# EasyEDA Pro project cubicat_pcb.eprj, board PCB_audio
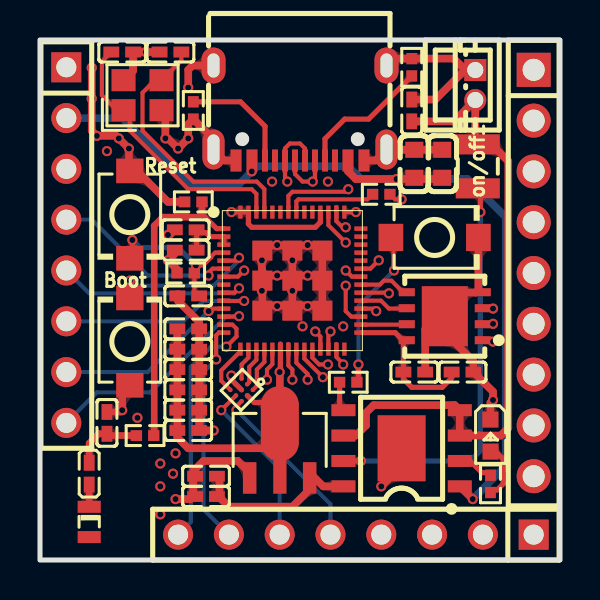
[diagram p11: board, top side]
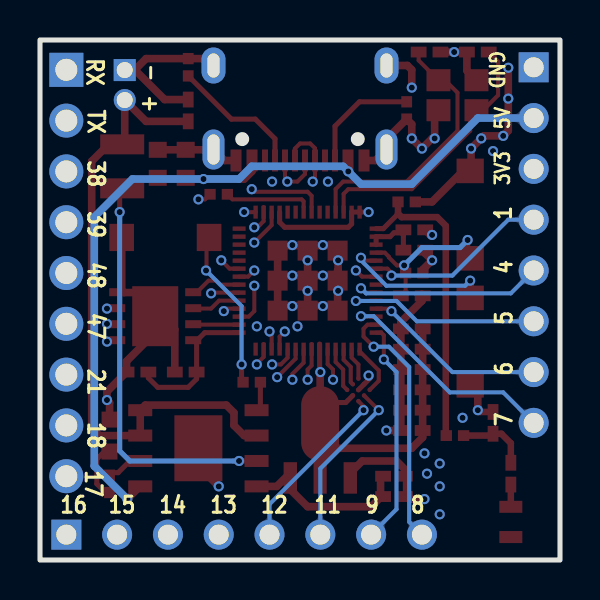
[diagram p12: board, bottom side, seen from below]

Outline 26 x 26 mm; copper layers: Top Layer, GND, PWR, Bottom Layer. Coordinates in mm from the lower left corner of the outline.
Outline path: rectangle 0,26 26,0
Stack: Top Layer 0.035mm 外层铜厚1oz / Dielectric1 0.2104mm 7628 RC49% 8.6mil / GND 0.0152mm 内层铜厚 / Dielectric2 1.065mm 1.1mm H/HOZ 含铜 / PWR 0.0152mm 内层铜厚 / Dielectric3 0.2104mm 7628 RC49% 8.6mil / Bottom Layer 0.035mm 外层铜厚1oz

## Design rules (mm)
net D-: USB-OTG
net D+: USB-OTG
template: 自定义配置
spacing copperThickness1oz (default): track to track 0.102, other pairs 0.152 to 0.3
spacing copperThickness2oz: track to track 0.203, other pairs 0.152 to 0.3
track width copperThickness1oz (default): min 0.127, default 0.254, max 2.54
track width copperThickness2oz: min 0.203, default 0.254, max 2.54
differential pair 90ohm (default): width min 0.203, default 0.203, max 0.229; gap min 0.152, default 0.203
via viaSize (default): diameter min 0.5, default 0.508, max 10; hole min 0.3, default 0.305, max 6.299

## Placement (name value [footprint] x y rotation side)
ANT1  KH-1608-H08  [ANT-SMD_L1.7-W0.9]  2.46 1.9 90 top
BAT1  A1501WV-2P  [CONN-TH_A1501WV-2P]  21.76 23.75 270 top
Boot  TS-1088-AR02016  [SW-SMD_L3.9-W3.0-P4.45]  4.49 10.92 90 top
C4  10uF  [C0402]  18.59 22.48 90 top
C6  10uF  [C0402]  8.3 3.17 180 top
C7  10uF  [C0603]  20.11 19.81 270 top
C8  10uF  [C0603]  18.72 19.81 270 top
C9  10uF  [C0402]  8.3 4.19 180 top
C13  10uF  [C0402]  7.41 7.49 180 top
C14  100nF  [C0402]  7.41 6.47 180 top
C15  1uF  [C0402]  7.41 13.21 0 top
C16  10uF  [C0402]  7.41 9.52 180 top
C17  1uF  [C0402]  7.41 11.56 180 top
C18  100nF  [C0402]  7.28 16.51 0 top
C20  15pF  [C0402]  4.11 25.4 0 top
C21  15pF  [C0402]  6.52 25.4 0 top
C22  1uF  [C0402]  7.41 8.51 180 top
C23  100nF  [C0402]  18.72 9.4 180 top
C24  1uF  [C0402]  21.13 9.4 180 top
C25  1.5pF  [C0402]  3.35 6.86 270 top
C30  10uF  [C0402]  7.41 10.54 180 top
ESP32S3R8  -  [esp32s3R8]  12.62 13.97 0 top
H1  PZ254V-11-09P  [HDR-TH_9P-P2.54-V-M]  24.68 14.35 270 top
L1  2.2uH  [IND-SMD_L2.5-W2.0_MHCHL2520]  21.89 19.68 90 top
L2  2nH  [L0402]  7.28 15.49 0 top
L3  5.6nH  [L0402]  2.46 4.32 90 top
LED1  19-213/Y2C-CQ2R2L/3T(CY)  [LED0603-RD-YELLOW]  22.53 6.22 270 top
on/off1  TS-1088-AR02016  [SW-SMD_L3.9-W3.0-P4.45]  19.73 16.13 0 top
Q1  AMS1117-3.3  [SOT-89_L4.5-W2.5-P1.50-LS4.2-BR]  11.98 5.46 270 top
R5  200Ω  [R0402]  22.53 3.81 90 top
R7  10kΩ  [R0402]  7.28 14.35 180 top
R9  5.1kΩ  [R0402]  7.67 22.48 90 top
R10  5.1kΩ  [R0402]  18.59 24.64 90 top
R11  10kΩ  [R0402]  15.41 8.89 0 top
R14  0Ω  [R0402]  5.25 6.22 0 top
R15  0Ω  [R0402]  7.67 17.91 0 top
R22  470Ω  [R0402]  17.06 18.29 0 top
Reset  TS-1088-AR02016  [SW-SMD_L3.9-W3.0-P4.45]  4.49 17.27 270 top
U6  IP5305T  [ESOP-8_L4.9-W3.9-P1.27-LS6.0-BL-EP]  18.08 5.59 90 top
U22  HB-PH3-25418PB2GOP  [HDR-TH_8P-P2.54-V-M]  15.79 1.27 180 top
U24  HB-PH3-25418PB2GOP  [HDR-TH_8P-P2.54-V-M]  1.32 15.75 270 top
U25  MAX98357AEWL+T  [WLP-9_L1.4-W1.3-P0.40-R3-C3-BR]  10.08 8.51 45 top
U26  W25Q64JVXGIQ  [XSON-8_L4.0-W4.0-P0.80-TL-EP]  20.24 12.19 180 top
USB1  TYPE-C 16PIN 2MD(073)  [USB-C-SMD_TYPE-C-6PIN-2MD-073]  13 22.35 180 top
X1  40MHz  [CRYSTAL-SMD_4P-L2.5-W2.0-BL]  5.13 23.24 0 top

## Footprints (pads in the part's own frame, mm; a bottom-side part is the same pattern mirrored in y, then rotated)
ANT-SMD_L1.7-W0.9
  rect 0.6x1.15 smd: 1(-0.756,0) 2(0.756,0)
C0402
  rect 0.79x0.54 smd: 1(-0.545,0) 2(0.545,0)
C0603
  rect 0.8x0.9 smd: 1(-0.7,0) 2(0.7,0)
CONN-TH_A1501WV-2P
  rect 1.1x1.1 hole 0.8: 1(-0.75,0)
  round 1.1 hole 0.8: 2(0.75,0)
CRYSTAL-SMD_4P-L2.5-W2.0-BL
  rect 1.2x1.1 smd: 1(-0.95,-0.75) 2(0.95,-0.75) 3(0.95,0.75) 4(-0.95,0.75)
ESOP-8_L4.9-W3.9-P1.27-LS6.0-BL-EP
  rect 0.6x1.2 smd: 1(-1.905,-2.909) 2(-0.635,-2.909) 3(0.635,-2.909) 4(1.905,-2.909) 5(1.905,2.909) 6(0.635,2.909) 7(-0.635,2.909) 8(-1.905,2.909)
  rect 3.3x2.4 smd: 9(0,0)
esp32s3R8
  rect 0.65x0.22 smd: 1(-3.425,2.6) 2(-3.425,2.2) 3(-3.425,1.8) 4(-3.425,1.4) 5(-3.425,1) 6(-3.425,0.6) 7(-3.425,0.2) 8(-3.425,-0.2) 9(-3.425,-0.6) 10(-3.425,-1) 11(-3.425,-1.4) 12(-3.425,-1.8) 13(-3.425,-2.2) 14(-3.425,-2.6) 29(3.425,-2.6) 30(3.425,-2.2) 31(3.425,-1.8) 32(3.425,-1.4) 33(3.425,-1) 34(3.425,-0.6) 35(3.425,-0.2) 36(3.425,0.2) 37(3.425,0.6) 38(3.425,1) 39(3.425,1.4) 40(3.425,1.8) 41(3.425,2.2) 42(3.425,2.6)
  rect 0.22x0.65 smd: 15(-2.6,-3.425) 16(-2.2,-3.425) 17(-1.8,-3.425) 18(-1.4,-3.425) 19(-1,-3.425) 20(-0.6,-3.425) 21(-0.2,-3.425) 22(0.2,-3.425) 23(0.6,-3.425) 24(1,-3.425) 25(1.4,-3.425) 26(1.8,-3.425) 27(2.2,-3.425) 28(2.6,-3.425) 43(2.6,3.425) 44(2.2,3.425) 45(1.8,3.425) 46(1.4,3.425) 47(1,3.425) 48(0.6,3.425) 49(0.2,3.425) 50(-0.2,3.425) 51(-0.6,3.425) 52(-1,3.425) 53(-1.4,3.425) 54(-1.8,3.425) 55(-2.2,3.425) 56(-2.6,3.425)
  rect 1x1 smd: 57(-1.5,1.5) 57(-1.5,0) 57(-1.5,-1.5) 57(0,1.5) 57(0,0) 57(0,-1.5) 57(1.5,1.5) 57(1.5,0) 57(1.5,-1.5)
HDR-TH_8P-P2.54-V-M
  rect 1.5x1.5 hole 1: 1(-8.89,0)
  round 1.5 hole 1: 2(-6.35,0) 3(-3.81,0) 4(-1.27,0) 5(1.27,0) 6(3.81,0) 7(6.35,0) 8(8.89,0)
HDR-TH_9P-P2.54-V-M
  rect 1.7x1.7 hole 1.1: 1(-10.16,0)
  round 1.7 hole 1.1: 2(-7.62,0) 3(-5.08,0) 4(-2.54,0) 5(0,0) 6(2.54,0) 7(5.08,0) 8(7.62,0) 9(10.16,0)
IND-SMD_L2.5-W2.0_MHCHL2520
  rect 1x2.2 smd: 1(-1.1,0) 2(1.1,0)
L0402
  rect 0.79x0.54 smd: 1(-0.545,0) 2(0.545,0)
LED0603-RD-YELLOW
  rect 0.8x0.8 smd: 1(-0.799,-0.004) 2(0.799,0.004)
R0402
  rect 0.566x0.54 smd: 1(-0.433,0) 2(0.433,0)
SOT-89_L4.5-W2.5-P1.50-LS4.2-BR
  rect 1.575x0.672 smd: 1(1.356,-1.5) 3(1.356,1.5)
  custom 5.377x1.9 smd: 2(-1.356,0.009)
SW-SMD_L3.9-W3.0-P4.45
  rect 1.23x1.36 smd: 1(-2.185,0) 2(2.185,0)
USB-C-SMD_TYPE-C-6PIN-2MD-073
  rect 0.55x1.1 smd: 1(-3.2,2.375) 2(-2.4,2.375) 11(2.4,2.375) 12(3.2,2.375)
  rect 0.3x1.1 smd: 3(-1.75,2.375) 4(-1.25,2.375) 5(-0.75,2.375) 6(-0.25,2.375) 7(0.25,2.375) 8(0.75,2.375) 9(1.25,2.375) 10(1.75,2.375)
  oval 1.1x2 hole 0.6x1.5: 13(-4.325,1.825) 14(4.325,1.825)
  oval 1.2x1.8 hole 0.6x1.2: 13(-4.325,-2.375) 14(4.325,-2.375)
WLP-9_L1.4-W1.3-P0.40-R3-C3-BR
  round 0.23 smd: A1(0.4,-0.4) A2(0,-0.4) A3(-0.4,-0.4) B1(0.4,0) B2(0,0) B3(-0.4,0) C1(0.4,0.4) C2(0,0.4) C3(-0.4,0.4)
XSON-8_L4.0-W4.0-P0.80-TL-EP
  rect 0.8x0.4 smd: 1(-1.9,1.2) 2(-1.9,0.4) 3(-1.9,-0.4) 4(-1.9,-1.2) 5(1.9,-1.2) 6(1.9,-0.4) 7(1.9,0.4) 8(1.9,1.2)
  rect 2.3x3 smd: 9(0,0)

## Nets
As in the schematic.

Pads without a net: ANT1 1; ESP32S3R8 8 28 38 39 40 41 42 51 52; USB1 3 9

## Via types
v1: diameter 0.508, hole 0.305, Top Layer to Bottom Layer, 85 vias

## Routing (per net, layer and track width the routed paths; a pad name or vN(x,y) marks a point on that pad's centre or on a via; arc(x,y) is an arc through that point)
GND: length 86.4
  Top Layer w0.254: v1(9.57,9.22) 9.5,9.15 9.5,9.09 U25.C2 U25.B2
  Top Layer w0.33: v1(4.11,7.49) 4.02,7.4 C25.1
  Top Layer w0.381: C23.1 19.26,11.53 19.9,12.17 ; USB1.1 16.78,19.97 USB1.13 17.34,20.51 C8.1 C7.1 ; 6.9,13.3 6.9,12.95 7.96,11.9 C17.1 C30.1 C16.1 C22.1 C13.1 C14.1 v1(8.68,6.47) ; v1(17.06,3.68) 18.08,4.7 U6.9 ; 11.09,14.22 v1(11.86,14.22) 12.62,14.22 ; 11.09,14.22 11.09,14.45 11.12,14.48 11.09,14.5 v1(11.09,14.98) 11.12,15.01 11.12,15.72 12.62,15.72 ; 11.09,14.22 v1(11.09,13.46) 11.12,13.44 11.12,12.72 12.62,12.72 ; 12.62,12.72 v1(12.62,13.46) 12.62,14.22 ; 12.62,12.72 14.12,12.72 14.12,14.22 ; 21.27,24.5 21.24,24.5 19.77,23.02 C4.2 ; 21.27,24.5 20.69,25.07 R10.2 17.62,25.07 17.32,24.77 USB1.13 ; 21.27,24.5 BAT1.1 ; 14.12,14.22 14.12,15.72 12.62,15.72 ; 14.12,14.22 v1(13.38,14.22) 12.62,14.22 ; R15.1 6.4,17.91 4.45,19.85 v1(4.45,20.57) v1(3.94,21.08) 3.81,21.21 v1(2.84,21.21) 2.59,21.46 v1(2.59,23.07) v1(2.59,24.61) ; X1.2 6.27,22.3 v1(6.27,21.08) 6.4,21.08 v1(6.9,20.57) v1(7.41,21.08) 7.41,21.79 R9.1 8.68,21.03 USB1.14 9.22,19.97 USB1.12 ; 12.62,15.72 v1(12.62,14.98) 12.62,14.22 ; C21.1 v1(5.29,25.4) C20.2 4.66,24.47 X1.4 ; v1(4.11,7.49) 4.11,8.35 Boot.1 ; 19.9,12.17 19.9,11.7 21.67,9.94 C24.1 22.65,8.42 v1(22.65,8) 22.52,7.87 22.52,7.27 ; 19.9,12.17 21.1,13.37 21.8,13.37 21.92,13.48 on/off1.2 ; USB1.14 7.63,24.72 7.41,24.51 v1(7.41,23.62) ; v1(6.4,16.25) 6.49,16.25 C18.1 ; v1(6.78,3.05) 7.54,3.05 7.67,3.17 7.67,4.44 8.17,4.95 9.89,4.95 10.48,4.36
  vias: v1(3.35,20.44) v1(4.87,7.11) v1(6.01,4.82) v1(6.01,3.68) v1(6.01,2.28) v1(6.65,4.32) v1(6.78,5.33) v1(11.6,18.92) v1(11.86,15.75) v1(11.86,12.7) v1(13.13,11.68) v1(13.38,15.75) v1(13.38,12.7) v1(14.4,18.92) v1(15.16,11.68)
VBUS_5V: length 46.4
  Top Layer w0.381: USB1.11 10.6,19.44 v1(10.59,19.43) ; C7.2 20.05,19.05 v1(17.83,19.05) 15.79,19.05 15.4,19.44 USB1.2 ; v1(21.64,3.05) 21,3.68 U6.1
  Bottom Layer w0.381: U24.2 4.11,22.1 7.41,18.79 9.95,18.79 v1(10.59,19.43) 10.84,19.68 15.41,19.68 16.05,19.05 v1(17.83,19.05) 21.38,19.05 23.29,17.14 23.29,4.7 v1(21.64,3.05)
VCC_3V3: length 35.3
  Top Layer w0.254: v1(9.57,17.4) 10.41,17.4 ESP32S3R8.55 10.42,16.8 10.59,16.64 13.76,16.64 14.02,16.89 ESP32S3R8.46 ; v1(11.98,9.4) 12.02,9.43 12.02,10.8 ; 11.99,7.23 11.35,7.87 10.71,7.87 U25.A2
  Top Layer w0.381: v1(11.98,9.4) 11.99,9.39 Q1.2 11.99,6.31 11.27,5.59 7.41,5.59 6.87,6.13 C14.2 C13.2 C22.2 C16.2 C30.2 C17.2 ; R7.2 6.85,14.53 v1(6.4,14.98) 6.74,15.33 6.74,15.36
  PWR w0.203: 11.86,14.98 11.22,15.62 ; 11.86,14.98 11.09,14.22 11.86,13.46 ; 11.86,14.98 12.49,15.62 12.75,15.62 13.89,14.48 13.89,13.84 13.76,13.71 ; 11.86,14.98 13.38,13.46 ; 11.86,13.46 12.49,12.83 ; 11.86,13.46 11.22,12.83
VCC_5V: length 8.9
  Top Layer w0.381: 8.97,4.19 8.97,3.14 9.44,2.67 12.62,2.67 13.48,3.53 13.48,4.36 14.16,3.68 U6.8
VDD_SPI: length 7.3
  Top Layer w0.254: ESP32S3R8.29 17.76,11.37 18.17,10.96 C23.2 18.17,9.05 18.59,8.63 20.11,8.63 20.58,9.11 C24.2
BAT: length 31.8
  Top Layer w0.381: C4.1 20.7,21.93 BAT1.2 21.76,21.04 22.02,20.78 22.57,20.78 23.41,19.94 23.41,6.6 23.03,6.22 U6.3 U6.4 20.73,7.75 16.68,7.75 16.3,7.36 16.3,6.73 15.79,6.22 U6.6
BOOT: length 7.9
  Top Layer w0.203: v1(9.95,15.11) 9.81,14.97 ESP32S3R8.5
  Top Layer w0.381: v1(4.49,13.97) Boot.2
  Bottom Layer w0.203: v1(9.95,15.11) 9.95,14.98 8.68,13.71 4.75,13.71 v1(4.49,13.97)
D+: length 15.1
  Top Layer w0.203: USB1.6 13.25,19.98 13.25,20.57 13,20.83 12.49,20.83 12.25,20.58 USB1.8 12.25,19.04 v1(12.37,18.92) ; ESP32S3R8.26 14.42,11.32 v1(14.52,11.43)
  PWR w0.203: v1(12.37,18.92) 12.75,18.54 12.75,18.29 12.37,17.91 12.37,17.58 14.24,15.71 14.24,13.37 15.67,11.94 15.67,11.3 15.43,11.06 14.89,11.06 v1(14.52,11.43)
D-: length 15.7
  Top Layer w0.203: USB1.5 13.75,19.04 v1(13.63,18.92) 13.13,18.92 12.75,19.3 USB1.7 ; ESP32S3R8.25 14.02,11.17 v1(13.76,11.43)
  PWR w0.203: v1(13.63,18.92) 13.2,18.49 13.2,17.32 14.64,15.88 14.64,13.48 16.05,12.07 16.05,11.17 15.54,10.67 14.52,10.67 v1(13.76,11.43)
DAC_BCK: length 1.6
  Top Layer w0.203: ESP32S3R8.16 10.42,10.12 10.08,9.78 U25.C1
DAC_DIN: length 1.9
  Top Layer w0.203: U25.B1 10.46,8.89 10.46,9.65 10.82,10.01 ESP32S3R8.17
DAC_SD_MODE: length 2.3
  Top Layer w0.203: U25.A1 10.84,8.7 10.84,9.52 11.22,9.9 ESP32S3R8.18
DAC_WS: length 2.6
  Top Layer w0.203: 9.51,8.51 9.06,8.96 9.06,9.48 10.02,10.43 ESP32S3R8.15
GPIO1: length 9.3
  Top Layer w0.203: ESP32S3R8.6 8.63,14.57 8.43,14.36 v1(8.43,14.22)
  Bottom Layer w0.203: U24.4 2.59,17.02 5.38,14.22 v1(8.43,14.22)
GPIO2: length 1.1
  Top Layer w0.203: ESP32S3R8.7 9.9,14.17 v1(10.21,14.48)
GPIO4: length 10.1
  Top Layer w0.203: v1(9.95,13.59) 9.73,13.37 ESP32S3R8.9
  Bottom Layer w0.203: U24.5 2.46,13.33 9.7,13.33 v1(9.95,13.59)
GPIO5: length 10.3
  Top Layer w0.203: ESP32S3R8.10 9.21,12.95 v1(10.21,12.95)
  Bottom Layer w0.203: v1(10.21,12.95) 8.17,12.95 7.16,11.94 U24.6
GPIO6: length 9.2
  Top Layer w0.203: v1(8.43,12.44) 8.55,12.57 ESP32S3R8.11
  Bottom Layer w0.203: U24.7 5.38,9.4 v1(8.43,12.44)
GPIO7: length 11.6
  Top Layer w0.203: v1(9.95,12.19) 9.93,12.17 ESP32S3R8.12
  Bottom Layer w0.203: U24.8 2.84,8.38 5.51,8.38 9.32,12.19 v1(9.95,12.19)
GPIO8: length 12.7
  Top Layer w0.203: v1(9.32,10.67) 9.82,11.17 9.82,11.56 9.62,11.77 ESP32S3R8.13
  Bottom Layer w0.203: v1(9.32,10.67) 8.56,10.67 7.54,9.65 7.54,1.9 U22.8
GPIO9: length 11.2
  Top Layer w0.203: ESP32S3R8.14 8.94,11.37 8.81,11.24 v1(8.81,10.03)
  Bottom Layer w0.203: v1(8.81,10.03) 8.17,9.4 8.17,2.54 U22.7
GPIO14: length 11.8
  Top Layer w0.203: v1(11.35,9.02) 11.35,9.52 11.62,9.79 ESP32S3R8.19
  PWR w0.203: v1(11.35,9.02) 11.35,8.25 17.06,2.54 U22.4
GPIO15: length 12.8
  Top Layer w0.203: v1(12.62,9.02) 12.62,9.52 12.42,9.72 12.42,10.8
  PWR w0.203: v1(12.62,9.02) 16.05,5.58 16.56,5.58 19.6,2.54 U22.3
GPIO16: length 13.7
  Top Layer w0.203: v1(13.38,9.02) 13.38,9.3 12.82,9.86 ESP32S3R8.22
  PWR w0.203: v1(13.38,9.02) 15.92,6.47 16.94,6.47 U22.2
GPIO17: length 15.6
  Top Layer w0.203: v1(14.14,9.14) 13.22,10.07 ESP32S3R8.23
  PWR w0.203: U22.1 18.84,7.11 16.18,7.11 v1(14.14,9.14)
GPIO18: length 13.9
  Top Layer w0.203: v1(14.4,9.78) 13.96,9.78 13.62,10.12 ESP32S3R8.24
  PWR w0.203: v1(14.4,9.78) 16.43,7.75 21.13,7.75 H1.9
GPIO21: length 11.9
  Top Layer w0.203: 14.82,10.8 14.82,10.15 15.16,9.81 v1(15.16,9.78)
  PWR w0.203: H1.8 22.4,9.02 15.92,9.02 v1(15.16,9.78)
GPIO38: length 10.3
  Top Layer w0.203: v1(15.79,17.4) 15.79,17.39 ESP32S3R8.43
  PWR w0.203: H1.3 23.03,19.43 21,17.4 v1(15.79,17.4)
GPIO39: length 10.8
  Top Layer w0.203: 14.82,17.65 14.82,16.94 15.12,16.64 v1(15.29,16.64)
  PWR w0.203: 24.68,16.89 24.43,16.64 v1(15.29,16.64)
GPIO40: length 12.1
  Top Layer w0.203: v1(15.29,15.87) 14.42,16.74 ESP32S3R8.45
  PWR w0.203: H1.5 22.91,16.13 15.54,16.13 v1(15.29,15.87)
GPIO47: length 12.5
  Top Layer w0.203: v1(16.94,14.98) 16.52,14.57 ESP32S3R8.37
  PWR w0.203: v1(16.94,14.98) 21.25,14.98 23.41,12.83 23.41,10.54 H1.7
GPIO48: length 12.6
  Top Layer w0.203: ESP32S3R8.36 15.59,14.17 v1(15.29,14.48)
  PWR w0.203: v1(15.29,14.48) 16.43,15.62 21.38,15.62 24.68,12.32 H1.6
RESET: length 8
  Top Layer w0.203: ESP32S3R8.4 8.76,15.37 8.56,15.17 8.56,15.13 8.15,14.73 v1(7.79,14.73) 7.79,14.42 R7.1 7.72,13.45 C15.2
  Top Layer w0.254: Reset.2 4.62,15.21 v1(4.62,16)
  Bottom Layer w0.254: v1(4.62,16) 5,15.62 6.9,15.62 v1(7.79,14.73)
RXD: length 15.7
  Top Layer w0.203: 12.42,17.65 12.42,18.21 12.62,18.41 15.29,18.41 v1(15.41,18.54)
  PWR w0.203: H1.1 24.68,24.13 19.1,18.54 v1(15.41,18.54)
SPICLK: length 2.1
  Top Layer w0.203: ESP32S3R8.33 17.05,12.97 17.44,12.57 18,12.57
SPICS0: length 7.8
  Top Layer w0.203: U26.1 22.58,10.99 v1(22.65,10.92) ; ESP32S3R8.32 16.69,12.57 v1(16.81,12.44)
  PWR w0.203: v1(16.81,12.44) 21.13,12.44 v1(22.65,10.92)
SPID: length 2.5
  Top Layer w0.203: ESP32S3R8.35 16.99,13.77 17.19,13.97 17.57,13.97 18.17,13.37
SPIHD: length 2.3
  Top Layer w0.203: U26.7 18.32,11.77 ESP32S3R8.30
SPIQ: length 7.8
  Top Layer w0.203: v1(17.44,13.33) 17.41,13.37 ESP32S3R8.34 ; v1(22.65,11.81) 22.63,11.79 U26.2
  PWR w0.203: v1(22.65,11.81) 21.13,13.33 v1(17.44,13.33)
SPIWP: length 10.7
  Top Layer w0.203: U26.3 22.63,12.59 v1(22.65,12.57) ; v1(15.29,13.71) 15.29,12.44 15.56,12.17 ESP32S3R8.31
  PWR w0.203: v1(22.65,12.57) 21.25,13.97 15.54,13.97 v1(15.29,13.71)
TXD: length 8.9
  Top Layer w0.203: R22.2 17.75,18.03 v1(18.08,18.03)
  PWR w0.203: 24.68,21.97 20.75,18.03 v1(18.08,18.03)
VOUT+: length 8.7
  Top Layer w0.203: v1(9.82,7.49) 9.82,7.69 10.08,7.94
  Bottom Layer w0.203: U22.5 14.52,2.79 v1(9.82,7.49)
VOUT-: length 8.5
  Top Layer w0.203: U25.B3 v1(9.06,7.49)
  Bottom Layer w0.203: U22.6 11.98,4.57 v1(9.06,7.49)
$1N4062: length 20.2
  Top Layer w0.254: v1(22.02,17.4) 22.02,18.46 L1.1 ; v1(16.05,4.95) U6.7
  Bottom Layer w0.254: v1(16.05,4.95) 21.51,4.95 22.02,5.46 v1(22.02,17.4)
$1N4068: length 2.9
  Top Layer w0.254: 22.53,3.5 22.85,3.5 23.16,3.81 23.16,5.04 22.53,5.68
$1N4069: length 1.8
  Top Layer w0.254: U6.2 21.51,4.95 22.09,4.37 22.53,4.37
$1N4090: length 6.7
  Top Layer w0.254: 18.59,24.2 16.43,22.04 15.23,22.04 14.25,21.06 USB1.4
$1N4091: length 5.8
  Top Layer w0.254: R9.2 10.03,22.91 11.25,21.69 USB1.10
$1N4092: length 8
  Top Layer w0.203: v1(17.7,14.48) 17.67,14.5 17.67,16.13
  Top Layer w0.254: v1(15.92,9.78) 15.92,8.96 R11.2
  Bottom Layer w0.203: v1(15.92,9.78) 15.92,12.7 v1(17.7,14.48)
$1N4094: length 1.5
  Top Layer w0.254: U6.5 14.98,7.68 R11.1
$1N4114: length 13.4
  Top Layer w0.203: C21.2 7.07,24.98 X1.3 5.75,23.99 5.13,23.37 5.13,21.46 7.67,18.92 10.84,18.92 11.22,18.54 ESP32S3R8.53
$1N4115: length 13.5
  Top Layer w0.203: 3.56,25.4 3.09,24.93 3.09,23.24 3.84,22.49 X1.1 4.49,22.17 4.49,21.46 7.41,18.54 10.59,18.54 10.82,18.31 ESP32S3R8.54
$1N4126: length 2.7
  Top Layer w0.254: ESP32S3R8.3 ESP32S3R8.2 8.5,16.17 8.3,16.36 7.94,16.36 7.83,16.25 L2.2
$1N4130: length 1.1
  Top Layer w0.33: ANT1.2 L3.1
$1N4132: length 3.3
  Top Layer w0.33: L3.2 2.46,5.84 2.93,6.31 C25.2 3.44,6.22 4.57,6.22
$1N4134: length 15.1
  Top Layer w0.254: 8.1,17.32 8.1,17.3 8.84,16.57 ESP32S3R8.1
  Top Layer w0.33: R14.2 5.71,6.25 5.71,16.71 6.14,17.14 7.92,17.14 8.1,17.32 R15.2
$1N4203: length 4.2
  Top Layer w0.203: 12.82,17.65 12.82,17.93 12.92,18.03 16.38,18.03 R22.1

## Copper pours and planes (outline as drawn; the poured copper is in the pictures)
GND on Bottom Layer: -2.75,28.45 27.86,28.45 27.86,-2.03 -2.75,-2.03
GND on GND: -3.13,28.95 29,28.95 29,-4.19 -3.13,-4.19
VCC_3V3 on PWR: -2.49,27.94 27.99,27.94 27.99,-1.65 -2.49,-1.65

Small or netless copper shapes (teardrops, artwork), in the pictures only: 247 on Top Layer, 31 on Bottom Layer, 39 on PWR

## Text on the board
Bottom Silkscreen Layer: GND | 5V | 3V3 | 8 | 9 | 11 | 12 | 13 | 14 | 15 | 16 | - | + | TX | 38 | 39 | 48 | 47 | 21 | 18 | RX | 17 | 4 | 5 | 6 | 7 | 1
